# EAGLE board Mk4 Prototype (EAGLE 9.0.1), part 2 of 2 (continued)
## Tracks (layer width: path | path; a pad name or v marks a point on that pad's centre or on a via) (continued)
SDRAM_BA0  (via drill 0.3)
  Top 0.15: v39.3,48 v39.3,60 40.32,61.02 41.27,61.02 41.79,60.5 42.18,60.5 42.35,60.67 42.89,60.67 43.52,61.3 46.26,61.3 46.58,60.98 47.02,60.98 47.32,61.27 55.7,61.27 56.13,60.84 57.3,60.84 57.8,60.34 v57.8,59.5
  Bottom 0.15: IC2.50 33.2,59.9 33.3,60 v39.3,60 | IC2.20 43.15,47.9 43.05,48 v39.3,48 | v57.8,59.5 58,59.7 IC1.76
SDRAM_BA1  (via drill 0.3)
  Top 0.15: v38.8,47 38.77,47.02 38.77,60.73 v38.8,60.75 38.8,61 39.3,61.5 41.81,61.5 42.33,60.98 42.77,60.98 43.39,61.6 46.16,61.6 46.58,62.02 47.02,62.02 47.47,61.58 55.82,61.58 56.25,61.15 57.65,61.15 58.3,60.5 58.3,59.75 v58.55,59.5
  Bottom 0.15: v38.8,47 43.58,47 IC2.21 | v38.8,60.75 33.3,60.75 33.25,60.7 IC2.51 | v58.55,59.5 58.4,59.65 IC1.77
SDRAM_CKE  (via drill 0.3)
  Top 0.15: v33.55,48.75 33.55,46.49 33.52,46.47 33.52,45.77 37.57,41.73 43.02,41.73 44.27,42.98 44.27,46.48 45.32,47.52 47.69,47.52 47.72,47.5 52.83,47.5 53.07,47.75 53.07,48.07 53.38,48.38 53.92,48.38 54.47,48.92 54.47,49.32 55.26,50.1 59.2,50.1 60.3,51.2 60.3,53.9 62.4,56 v63.3,56
  Bottom 0.15: IC2.37 33.3,49.5 33.55,49.25 v33.55,48.75 | IC1.104 66.45,56.4 66.27,56.23 63.55,56.23 63.32,56 v63.3,56
SDRAM_CLK  (via drill 0.3)
  Top 0.15: v31.05,50.75 31.05,52.18 30.76,52.47 30.76,52.65 32.3,54.19 32.3,57.5 32.8,58 v34.3,58 | v45.2,58.5 v42.78,58.5
  Bottom 0.15: IC2.38 31.5,50.3 v31.05,50.75 | v42.78,58.5 41.29,58.5 41.02,58.77 35.07,58.77 v34.3,58 | IC1.62 48.08,58.4 47.98,58.5 v45.2,58.5
SDRAM_D15  (via drill 0.3)
  Top 0.15: v57.8,62.5 56.74,62.5 56.72,62.48 47.84,62.48 47.39,62.92 46.21,62.92 45.91,62.62 34.17,62.62 v33.8,62.25
  Bottom 0.15: IC2.53 33.25,62.3 33.3,62.25 v33.8,62.25 | IC1.78 58.8,61.5 58.57,61.73 58.41,61.73 58.27,61.86 58.27,62.02 v57.8,62.5
SDRAM_DQMH  (via drill 0.3)
  Top 0.15: v35.05,51.25 35.05,59.75 37.32,62.02 38.52,62.02 38.54,62 42.31,62 42.33,62.02 46.16,62.02 46.46,62.33 47.14,62.33 47.59,61.88 55.95,61.88 56.38,61.45 57.49,61.45 57.54,61.5 59.8,61.5 60.3,61 60.3,59.5 59.55,58.75 v59.55,58
  Bottom 0.15: IC2.39 32.9,51.1 33.05,51.25 v35.05,51.25 | IC1.82 60.4,58.85 v59.55,58
SDRAM_DQML  (via drill 0.3)
  Top 0.15: v42.55,51.75 43.55,51.75 43.8,52 43.8,57.2 43.3,57.7 42.5,57.7 42,58.2 42,59.9 42.47,60.38 43.02,60.38 43.64,61 46.13,61 46.46,60.67 47.14,60.67 47.44,60.98 55.57,60.98 57.05,59.5 57.05,59 58.05,58 v58.8,58
  Bottom 0.15: IC2.15 42.95,51.9 42.8,51.75 v42.55,51.75 | IC1.81 60,59.2 v58.8,58
SIM_CLK  (via drill 0.3)
  Top 0.2: v113.3,28.75 113.3,30.5 112.8,31 112.05,31 110.8,32.25 110.3,32.25 106.55,36 102.3,36 99.8,38.5 v99.8,39 | v99.3,55.15 99.3,54.77 99.7,54.37 99.7,53.05 99.3,52.65 v99.3,48
  Bottom 0.2: J1.C3 114.8,23.52 113.3,25.02 v113.3,28.75 IC10.2 | v99.8,39 99.58,39 99.28,38.7 98.82,38.7 98.25,39.27 98.25,41.23 99.05,42.03 99.05,47.75 v99.3,48 | R27.2 99.3,53.72 99.35,53.77 99.35,54.23 99.3,54.28 v99.3,55.15
SIM_CLK_R
  Bottom 0.2: IC5.16 99.2,51.9 R27.1 C49.2
SIM_CTS
  Bottom 0.2: R34.1 86.3,38.25 TP4.TP
SIM_CTS_R
  Bottom 0.15: IC5.4 R34.2
SIM_D_N
  Bottom 0.25: IC5.26 109.15,42.65 109.5,43 109.9,43 arc90 111.6,44.7 111.6,49.07 arc-90 JP9.2
SIM_D_P
  Bottom 0.25: IC5.25 109.15,43.75 109.5,43.4 109.9,43.4 arc90 111.2,44.7 111.2,49.06 arc90 JP9.3
SIM_DATA  (via drill 0.3)
  Top 0.2: v111.55,23.5 v114.05,26 | v114.05,29.25 114.05,30.25 112.8,31.5 112.05,31.5 110.8,32.75 110.3,32.75 106.55,36.5 102.3,36.5 100.55,38.25 v100.55,38.75 | v98.3,48 98.3,52.15 99.35,53.2 99.35,54.23 99.03,54.55 98.75,54.55 v98.3,55
  Bottom 0.2: J1.C7 110.67,23.5 v111.55,23.5 | v114.05,26 v114.05,29.25 113.8,29.5 IC10.1 | v100.55,38.75 100.33,38.75 99.93,38.35 98.68,38.35 97.9,39.13 97.9,41.37 98.55,42.02 98.55,47.75 v98.3,48 | R26.2 97.3,54 v98.3,55
SIM_DATA_R
  Bottom 0.2: C50.2 R26.1 97.3,51.5 98.1,50.7 IC5.15
SIM_DCD
  Bottom 0.2: R33.1 87.8,39.25 TP3.TP
SIM_DCD_R
  Bottom 0.15: IC5.5 90.4,39.35 R33.2
SIM_DET  (via drill 0.3)
  Top 0.2: v97,34 107.55,34 110.3,31.25 110.8,31.25 111.05,31 v111.05,30.6
  Bottom 0.2: IC5.14 v97,34 97,33.65 97.55,33.1 97.55,31.29 97.3,31.04 R29.2 | J1.C8 109.8,26.91 109.8,29.35 v111.05,30.6
SIM_DTR
  Bottom 0.2: R31.1 88.05,41.25 TP2.TP
SIM_DTR_R
  Bottom 0.15: R31.2 R40.1 90.5,40.45 IC5.6
SIM_NETLIGHT
  Bottom 0.15: R42.1 85.65,31.25 84,32.9 84,38.4 83.3,39.1 82.36,39.1 79.6,41.86 79.6,43.37 77.97,44.99 77.97,45.53 77.32,46.19 76.82,46.19 76.3,46.7 74.9,46.7 74.2,47.4 74.2,52.2 71.4,55 69.12,55 69.02,54.9 68.6,54.9 68.5,54.8 IC1.108
SIM_PWR_KEY
  Bottom 0.15: Q1.1 89.22,29 R30.1 87.2,29 86.8,29.4 84.8,29.4 84.5,29.7 83.7,30.5 83.7,38.2 83.1,38.8 82.23,38.8 79.3,41.73 79.3,43.24 77.67,44.87 77.67,45.41 77.2,45.88 76.69,45.88 76.18,46.4 74.7,46.4 73.9,47.2 73.9,52.08 71.28,54.7 69.25,54.7 69.15,54.6 68.8,54.6 68.6,54.4 IC1.109
SIM_RI_R
  Bottom 0.15: IC5.7 91,41.55 R32.2
SIM_RST  (via drill 0.3)
  Top 0.2: v111.8,30 111.8,30.75 110.8,31.75 110.3,31.75 106.55,35.5 102.3,35.5 99.05,38.75 v99.05,39.25 | v100.3,54 v100.3,48
  Bottom 0.2: J1.C2 115.8,20.98 112.3,24.48 112.3,28.5 111.8,29 v111.8,30 111.8,31 112.22,31.43 IC10.4 | v99.05,39.25 99.05,40.25 99.55,40.75 99.55,47.25 v100.3,48 | R28.2 v100.3,54
SIM_RST_R
  Bottom 0.2: IC5.17 R28.1 C48.2
SIM_RTS
  Bottom 0.2: TP5.TP R35.1
SIM_RTS_R
  Bottom 0.15: IC5.3 92.35,37.25 R35.2 R39.1
SIM_RXD_R
  Bottom 0.15: IC5.2 91.1,36.05 R37.2 R38.1
SIM_STATUS
  Bottom 0.15: R41.1 86.35,32.25 84.3,34.3 84.3,38.6 83.5,39.4 82.48,39.4 79.9,41.98 79.9,43.49 78.28,45.12 78.28,45.66 77.45,46.48 76.94,46.48 76.43,47 75.1,47 74.5,47.6 74.5,52.1 74.5,52.2 74.5,52.4 71.6,55.3 69,55.3 68.9,55.2 IC1.107
SIM_STATUS_R
  Bottom 0.15: R41.2 95.85,32.25 IC5.42
SIM_TXD_R
  Bottom 0.15: IC5.1 91.5,34.95 91.05,34.5 91.05,33.5 90.8,33.25 R36.2
SIM_VBUS
  Bottom 0.25: IC5.24 109.15,44.85 arc90 109.8,45.5 109.8,49.19 JP9.4
SIM_VDD  (via drill 0.3)
  Top 0.3: v114.8,31 114.8,31.25 112.8,33.25 110.55,33.25 106.8,37 102.55,37 101.3,38.25 v101.3,38.5
  Bottom 0.3: C51.2 115.3,14.5 115.3,17.25 116.49,18.44 J1.C1 118.8,19.33 118.8,26.95 118.3,27.45 115.35,27.45 114.8,28 v114.8,31 114.38,31.43 IC10.5 | v101.3,38.5 101.15,38.65 101.15,39 100.8,39.35 100.45,39.35 100.05,39.75 100.05,46.75 101.4,48.1 IC5.18
SOP0  (via drill 0.3)
  Top 0.2: v13.85,28.55 13.7,28.55 12.5,28.55 12.3,28.75 11.05,30 11.05,31.25 10.55,31.75 9.55,31.75 8.8,32.5 v8.8,32.75
  Bottom 0.2: IC15.35 14.55,27.85 v13.85,28.55 | R64.1 v8.8,32.75
SOP1  (via drill 0.3)
  Top 0.2: v7.8,32.75 9.8,30.75 9.8,29.25 10.05,29 11.27,29 12.47,27.8 v13.8,27.8
  Bottom 0.2: IC15.34 14.05,27.55 v13.8,27.8 | R63.1 v7.8,32.75
SOP2
  Bottom 0.15: IC15.21 12.3,20.75 11.97,20.43 11.97,17.43 R62.1
SPK_AMP_N  (via drill 0.3)
  Top 0.2: v27.05,52 26.8,52.25 26.8,57 v25.3,58.5
  Bottom 0.2: v25.3,58.5 12.3,58.5 U5.- | IC13.8 26.52,51.48 v27.05,52
SPK_AMP_P
  Bottom 0.2: IC13.5 24.57,51.73 24.3,52 15.3,52 10.8,47.5 U5.+
SPK_N  (via drill 0.3)
  Top 0.2: v48.8,29.9 49.02,29.68 72.23,29.68 75.62,33.07 75.62,45.74 77.23,47.34 79.12,47.34 v79.39,47.62 79.56,47.45 v82.4,47.45 | v30.1,38.7 30.07,38.67 29.37,38.67 26.67,41.37 26.67,42.67 v27.2,43.2
  Bottom 0.2: IC5.12 92.4,47 C68.2 | C65.1 C68.2 | C67.1 C64.2 | C64.2 C68.2 | C64.2 88.97,46.67 84.22,46.67 84.07,46.83 82.82,46.83 82.4,47.25 v82.4,47.45 | v48.8,29.9 48.57,29.68 47.57,29.68 46.07,31.18 44.97,31.18 37.67,38.48 30.32,38.48 v30.1,38.7 | C82.2 24.6,43.25 25.2,42.65 26.65,42.65 v27.2,43.2 | v79.39,47.62 79.9,47.11 79.9,47.05 80.45,46.5 R43.1
SPK_P  (via drill 0.3)
  Top 0.2: v48.8,29.1 49.02,29.32 72.37,29.32 75.97,32.93 75.97,45.59 77.37,46.99 79.17,46.99 v79.55,46.61 | v30.1,37.9 29.67,38.33 29.23,38.33 26.32,41.23 26.32,43.12 v26.4,43.2
  Bottom 0.2: IC5.11 90.35,45.95 C68.1 | C68.1 C64.1 | C69.1 C68.1 | C66.1 C64.1 | C64.1 88.97,46.33 84.08,46.33 83.93,46.48 81.57,46.48 R45.1 80.77,45.72 80.34,45.72 79.55,46.51 v79.55,46.61 | v30.1,37.9 30.32,38.12 37.53,38.12 44.83,30.82 45.93,30.82 47.43,29.32 48.57,29.32 v48.8,29.1 | C83.2 25.6,43.2 v26.4,43.2
SPK_R_N
  Bottom 0.15: R45.2 R46.1 81.55,51 81.55,51.05 81.55,51.23 IC11.5
SPK_R_P
  Bottom 0.15: R43.2 R51.1 R50.1 80.55,51 80.55,51.09 80.55,51.27 IC11.6
SSI0_LCD_CLK
  Bottom 0.15: J2.37 54.05,38.5 55,39.45 55,41.1 53.4,42.7 51.55,42.7 51,43.25 51,47.3 51.3,47.6 IC1.35
SSI0_LCD_CS
  Bottom 0.15: J2.38 53.55,38.5 54.67,39.62 54.67,40.92 54.3,41.29 54.3,41.38 53.28,42.4 51.42,42.4 50.7,43.12 50.7,47.42 51.28,48 IC1.36
SSI0_LCD_MISO  (via drill 0.3)
  Top 0.15: v53.6,39.8 54.1,39.8 55.3,41 v56.25,41
  Bottom 0.15: IC1.38 51.1,48.8 50.1,47.8 50.1,42.88 51.18,41.8 53,41.8 53.6,41.2 v53.6,39.8 | v56.25,41 56.05,40.8 J2.33
SSI0_LCD_MOSI  (via drill 0.3)
  Top 0.15: v54.15,40.7 54.5,40.7 55.5,41.7 v55.85,41.7
  Bottom 0.15: J2.34 55.55,38.5 55.6,38.55 55.6,41.45 v55.85,41.7 | IC1.37 51.2,48.4 50.4,47.6 50.4,43 51.3,42.1 53.15,42.1 54,41.25 54,41.1 54.15,40.95 v54.15,40.7
SSI2_CC_!CS  (via drill 0.3)
  Top 0.15: v30.8,28 31.5,28 36.2,32.7 44.7,32.7 45.9,31.5 56.98,31.5 57.68,32.2 v59.3,32.2 | v65.8,43.2 65.8,42.91 65.4,42.51 65.4,34.6 v64.4,33.6
  Bottom 0.15: IC15.8 17.55,14.9 18.05,14.4 18.55,14.4 19.1,14.95 26.75,14.95 27.8,16 27.8,18.8 30.1,21.1 30.1,27.35 30.75,28 v30.8,28 | IC1.3 65.2,43.8 v65.8,43.2 | v64.4,33.6 61.26,33.6 60.76,34.1 60,34.1 59.3,33.4 v59.3,32.2
SSI2_CC_CLK  (via drill 0.3)
  Top 0.15: v30.8,30.4 32.63,30.4 35.83,33.6 45.2,33.6 46.4,32.4 56.6,32.4 58.6,34.4 v61.2,34.4 | v65,43.2 65,41.49 65.02,41.47 65.02,35.02 v64.4,34.4
  Bottom 0.15: IC15.5 19.05,17.5 20.6,15.95 24.68,15.95 24.7,15.93 26.39,15.93 26.9,16.43 26.9,19.2 29.2,21.5 29.2,28.8 v30.8,30.4 | IC1.4 64.8,43.4 v65,43.2 | v61.2,34.4 v64.4,34.4
SSI2_CC_MISO  (via drill 0.3)
  Top 0.15: v30.8,28.8 31.88,28.8 36.08,33 44.88,33 46.08,31.8 56.85,31.8 57.8,32.75 v60.4,32.75 | v66.55,43.24 66.33,43.01 66.33,42.98 65.7,42.36 65.7,33.8 64.7,32.8 v64.4,32.8
  Bottom 0.15: IC15.7 18.05,17 R71.1 18.8,16.75 20.3,15.25 26.56,15.25 27.5,16.18 27.5,18.95 29.8,21.25 29.8,27.8 v30.8,28.8 | IC1.1 66,44.6 66.4,44.2 66.4,43.39 v66.55,43.24 | v64.4,32.8 64.35,32.75 v60.4,32.75
SSI2_CC_MOSI  (via drill 0.3)
  Top 0.15: v30.8,29.6 32.25,29.6 35.95,33.3 45,33.3 46.2,32.1 56.73,32.1 58.13,33.5 v60.4,33.5 | v65.8,44 66.7,44 67.3,43.4 67.3,42.8 66.7,42.2 66.5,42.2 66,41.7 66,33.4 64.6,32 v64.4,32
  Bottom 0.15: IC15.6 18.55,17.5 20.4,15.65 24.55,15.65 24.58,15.62 26.52,15.62 27.2,16.31 27.2,19.07 29.5,21.37 29.5,28.3 v30.8,29.6 | IC1.2 65.6,44.2 v65.8,44 | v60.4,33.5 60,33.5 59.8,33.3 59.8,32.6 60.4,32 v64.4,32
SSI3_CLK
  Bottom 0.15: IC6.6 69.13,42.5 64.7,42.5 64.4,42.8 IC1.5
SSI3_DAT0  (via drill 0.3)
  Top 0.15: v62.5,47.2 62.25,46.95 62.25,46.35 62,46.1 62,42 62.6,41.4 62.6,40.3 v62.5,40.2
  Bottom 0.15: IC1.11 62,46.1 62.25,46.35 62.25,46.95 v62.5,47.2 | IC6.5 64.95,41.24 63.91,40.2 v62.5,40.2
SSI3_DAT1  (via drill 0.3)
  Top 0.15: v74.1,43.8 68.06,43.8 66.6,45.26 66.6,47.5 64.5,49.6 63.25,49.6 63.15,49.5 62.4,49.5 62.1,49.8 60.45,49.8 60.15,49.5 56,49.5 55.6,49.1 55.6,47.94 55.38,47.72 55.38,47.28 55.6,47.06 v55.6,46.6
  Bottom 0.15: IC1.27 v55.6,46.6 | IC6.2 74.11,43.78 v74.1,43.8
SSI3_DAT2  (via drill 0.3)
  Top 0.15: v74.1,42.5 73.1,43.5 67.9,43.5 67.15,44.25 67.08,44.33 66.3,45.1 66.3,47.38 64.38,49.3 63.38,49.3 63.28,49.2 62.27,49.2 61.97,49.5 60.58,49.5 60.28,49.2 56.4,49.2 55.9,48.7 v55.9,47.5
  Bottom 0.15: IC6.3 74.11,42.52 v74.1,42.5 | v55.9,47.5 55.6,47.5 55.1,47 54.5,47 54.22,47.27 54.22,47.32 54.2,47.34 54.2,48.25 54.52,48.58 55.22,48.58 55.44,48.8 55.6,48.8 55.8,49 55.8,51.1 54.47,52.42 53.58,52.42 53.16,52 IC1.46
  Bottom 0.2: IC6.3 77.53,42.52 R10.2
SSI3_DAT3
  Bottom 0.15: R9.2 66.7,44.35 66.7,46 66.42,46.27 64.97,46.27 63.9,47.35 63.3,47.35 63.07,47.58 63.07,48.7 63.58,49.2 63.68,49.2 64.88,50.4 IC1.119
  Bottom 0.2: IC6.7 69.11,43.75 R9.2
SSI3_FSS  (via drill 0.3)
  3V3@2 0.15: v71.4,42.2 71.4,42.6 71.4,42.7 73.75,45.05 v74.05,45.05
  Bottom 0.15: IC1.6 64,42.5 64.6,41.9 70.5,41.9 70.8,42.2 v71.4,42.2 | v74.05,45.05 IC6.1
SW
  Bottom 0.25: IC3.6 32.9,14.35
  Bottom 0.5: 32.9,14.35 L4.1
T3CCPO_WS2812  (via drill 0.3)
  Top 0.2: 49.8,72.35 49.8,70 53.6,66.2 56.8,66.2 57.7,65.3 59.6,65.3 62,62.9 70.4,62.9 v75.6,57.7 | v75.6,55.3 77,53.9 77,51.5 74.1,48.6 v70.1,48.6
  Top 0.3: LED1.4 49.8,72.35
  Bottom 0.2: v75.6,57.7 v75.6,55.3 | v70.1,48.6 69.83,48.33 69.16,48.33 68.84,48 IC1.125
T_X
  Bottom 0.15: J2.44 50.55,38.35 49.8,39.1 49.8,40.8 49.8,40.9 49.8,50.4 50.2,50.8 IC1.43
T_Y
  Bottom 0.15: IC1.44 50.1,51.2 49.5,50.6 49.5,38.92 50.05,38.37 J2.45
TCA_INT  (via drill 0.3)
  Top 0.15: v53.5,34.5 53.8,34.2 55.86,34.2 59.3,37.64 59.3,39 59.8,39.5 59.8,40 57.7,42.1 57.7,44.1 v60.2,46.6
  Bottom 0.15: 73.8,27.25 54.25,27.25 53.5,28 v53.5,34.5 | IC1.15 60.4,46.4 v60.2,46.6
  Bottom 0.2: IC4.22 75.3,26.25 74.85,26.7 74.85,26.92 74.52,27.25 73.8,27.25
TCK_SWCLK  (via drill 0.3)
  Top 0.2: v81.55,63.75 v81.55,67.25
  Bottom 0.2: J3.4 90.97,63.83 87.8,67 81.8,67 v81.55,67.25 | JP4.4 82.94,61.36 81.55,62.75 v81.55,63.75 81.35,63.95 81.35,63.98 81.03,64.3 80.57,64.3 80.52,64.25 77.05,64.25 70.8,58 IC1.100
TDI
  Bottom 0.2: J3.8 88.43,64.87 87.3,66 79.05,66 78,64.95 76.76,64.95 74.81,63 74.8,63 70.6,58.8 IC1.98
TDO_SWO  (via drill 0.3)
  Top 0.2: v80.8,66.75 v80.8,63.75
  Bottom 0.2: J3.6 89.7,64.35 87.55,66.5 81.05,66.5 v80.8,66.75 80.55,66.5 78.8,66.5 77.6,65.3 76.61,65.3 74.81,63.5 74.8,63.5 70.5,59.2 IC1.97 | JP4.6 82.46,60.09 80.8,61.75 v80.8,63.75
TMS_SWDIO  (via drill 0.3)
  Top 0.2: v82.3,67.75 v82.3,63.75
  Bottom 0.2: J3.2 92.24,63.31 88.05,67.5 82.55,67.5 v82.3,67.75 | JP4.2 82.92,62.63 82.3,63.25 v82.3,63.75 82.3,64 81.55,64.75 78.3,64.75 78.15,64.6 76.91,64.6 74.8,62.5 70.7,58.4 IC1.99
TPS_FB
  Bottom 0.25: IC3.2 R61.1 R60.2 C103.2
UART1_SIM_RI  (via drill 0.3)
  Top 0.15: v75.9,52.6 71.3,52.6 70.8,52.1 66.9,52.1 v66.2,52.8
  Bottom 0.15: R32.1 88.77,42.25 88.52,42.5 81.15,42.5 80.8,42.85 80.8,43.9 79.57,45.12 79.54,45.12 79.17,45.49 79.17,46.03 77.82,47.38 77.31,47.38 76.8,47.9 75.7,47.9 75.4,48.2 75.4,52.1 v75.9,52.6 | IC1.112 66.6,53.2 v66.2,52.8
UART1_SIM_RX  (via drill 0.3)
  Top 0.15: v65.7,59.1 65.8,59 72.35,59 v73.15,58.2
  Bottom 0.15: R36.1 85.8,33.25 84.6,34.45 84.6,38.75 83.65,39.7 82.6,39.7 80.2,42.1 80.2,43.62 78.57,45.24 78.57,45.78 77.57,46.78 77.07,46.78 76.55,47.3 75.28,47.3 74.8,47.78 74.8,52.88 74.6,53.08 74.6,54.35 74.3,54.65 74.3,57.05 v73.15,58.2 | IC1.95 65.6,59.2 v65.7,59.1
UART1_SIM_TX  (via drill 0.3)
  Top 0.15: v66.3,59.6 72.5,59.6 v73.9,58.2
  Bottom 0.15: R37.1 86.05,35.25 84.9,36.4 84.9,38.9 83.8,40 82.73,40 80.5,42.23 80.5,43.74 78.88,45.37 78.88,45.91 77.7,47.09 77.19,47.09 76.68,47.6 75.4,47.6 75.1,47.9 75.1,53 74.9,53.2 74.9,54.48 74.6,54.78 74.6,57.5 v73.9,58.2 | IC1.96 66,59.9 v66.3,59.6
UART3_CC_RX  (via drill 0.3)
  Top 0.15: v23.55,19.75 24.55,18.75 24.55,16.25 25.55,15.25 26.05,15.25 26.6,15.8 26.6,16.87 27.3,17.57 27.3,19.15 27.6,19.45 27.6,20.67 29.75,22.82 29.75,31.37 30.68,32.3 33.26,32.3 35.46,34.5 45.9,34.5 47.1,33.3 56.23,33.3 60.2,37.27 60.2,38.4 60.7,38.9 60.7,40.5 58.6,42.6 58.6,43.5 60.57,45.48 60.67,45.48 61.4,46.21 61.4,46.63 61.62,46.86 61.62,47.54 61.05,48.12 v61.05,48.5
  Bottom 0.15: IC15.55 22.3,23.25 23.15,22.4 23.15,20.15 v23.55,19.75 R68.1 | IC1.116 64.7,51.6 64.3,51.2 63.75,51.2 v61.05,48.5
UART3_CC_TX  (via drill 0.3)
  Top 0.15: v23.55,17.75 24.25,17.05 24.25,16.05 25.35,14.95 26.25,14.95 26.9,15.6 26.9,16.75 27.6,17.45 27.6,19.03 27.9,19.33 27.9,20.55 30.05,22.7 30.05,31.25 30.8,32 33.38,32 35.58,34.2 45.6,34.2 46.8,33 56.35,33 60.5,37.15 60.5,38.22 61,38.72 61,40.7 60.9,40.8 60.9,45.28 61.7,46.09 61.7,46.51 61.92,46.73 61.92,48.38 v61.8,48.5
  Bottom 0.15: IC15.57 22.05,22.25 22.45,21.85 22.45,18.85 v23.55,17.75 R69.1 | IC1.117 64.8,51.2 64.4,50.8 64.1,50.8 v61.8,48.5
UART5_EXT_RX  (via drill 0.3)
  Top 0.15: PCB.CH3 15.84,8.64 17.3,10.1 25.2,10.1 26.9,11.8 26.9,13.8 27.9,14.8 27.9,16.38 28.8,17.28 28.8,20.18 31.5,22.88 v31.5,23.5 | v59.2,39.7 59,39.5 59,37.77 55.73,34.5 54.5,34.5 53.8,35.2 52.6,35.2 51.9,34.5 46.9,34.5 46.3,35.1 35.21,35.1 33.31,33.2 v30.8,33.2
  Bottom 0.15: v59.2,39.7 58.98,39.92 58.98,41.57 58.5,42.05 58.5,43.68 59.2,44.38 IC1.18 | v30.8,33.2 31.8,32.2 31.8,23.8 v31.5,23.5
UART5_EXT_TX  (via drill 0.3)
  Top 0.15: PCB.CH4 12.39,10.4 25.08,10.4 26.6,11.92 26.6,13.92 27.6,14.92 27.6,16.5 28.5,17.4 28.5,20.3 30.7,22.5 30.7,23.8 v31,24.1 | v58.45,39.7 58.7,39.45 58.7,37.89 55.61,34.8 54.7,34.8 54,35.5 52.4,35.5 51.7,34.8 47.1,34.8 46.5,35.4 35.08,35.4 33.68,34 v30.8,34
  Bottom 0.15: v58.45,39.7 58.68,39.93 58.68,41.42 58.15,41.95 58.15,43.75 58.8,44.4 IC1.19 | v31,24.1 31.5,24.6 31.5,31.7 30.7,32.5 30.6,32.6 30.2,33 30.2,33.4 v30.8,34
USB_D_N
  Bottom 0.2: IC7.1 69.3,69.75
  Bottom 0.25: 69.3,69.75 68.5,68.95 68.5,67.45 69.4,66.55 69.4,66.35 69.45,66.3 69.45,65 arc-90 68.45,64 66.6,64 arc90 64.8,62.2 IC1.93 | U1.D- 69.35,71.75 69.4,71.7 69.4,70.5 69.3,70.4 IC7.1
USB_D_P
  Bottom 0.2: IC7.2 69.8,68.15 69.95,68
  Bottom 0.25: 69.95,68 69.95,66.4 69.85,66.3 69.85,65 arc-90 68.45,63.6 66.6,63.6 arc90 65.2,62.2 IC1.94 | U1.D+ 70,71.9 69.8,71.7 IC7.2
USB_ID
  Bottom 0.15: TP6.TP 72.05,65.5 R8.2
USB_ID_R
  Bottom 0.15: U1.ID 70.65,71.4 71.3,70.75 71.3,69.85 70.3,68.85 IC7.4 70.8,68.08 R8.1
USB_SHIELD
  Bottom 0.3: U1.SHIELD@5 74.19,73.7 U1.SHIELD@2 71.64,75.22 U1.SHIELD@1 69.39,75.41 69.21,75.59 U1.SHIELD@0 68.76,75.78 U1.SHIELD@3 66.92,75.07 U1.SHIELD 65.85,73.05 R7.1 64.42,72.5 C20.2
V_UNREG  (via drill 0.3)
  Top 0.2: v45.01,25.6 47.1,25.6 47.88,24.82 47.88,16.86 47.8,16.79 v47.8,15.45
  3V3@2 0.2: v41.55,31.25 41.55,27.25 43.2,25.6 v45.01,25.6
  3V3@2 1.25: v42.5,15.5 v43.3,15.5 43.35,15.45 v47.8,15.45 72.8,15.45 75.05,13.2 79.35,13.2 v81.05,11.5 v84.3,11.5 v85.3,11.5
  Bottom 0.2: 41.3,21.45 IC8.15 41.3,21 | IC8.16 40.8,21 | R18.2 v41.55,31.25
  Bottom 1.25: 91.42,5.38 v85.3,11.5 v81.05,11.5
  Bottom 1.5: PCB.VBATT 91.42,5.38
  pour Bottom (no thermals): 35.3,19 35.3,17.5 36.8,17.5 37.3,17 37.3,15.5 40.8,15.5 41.3,15 43.55,15 43.8,15.25 43.8,15.75 43.55,16 41.8,16 40.8,17 40.8,17.5 41.35,18.05 41.35,21.45 41.3,21.5 40.8,21.5 40.5,21.2 40.5,18.45 39.8,17.75 37.8,17.75 37.3,18.25 37.3,19
VBAT  (via drill 0.3)
  Bottom 0.15: IC8.14 41.8,21.35 | 42.6,20 C35.1 | IC8.13 42.3,21.35
  Bottom 1: J5.2 80.95,16.8 C34.1 | C34.1 79.4,16.65 v79.3,16.75 | C34.1 v80.8,18
  other vias: 42.3,18.5 43.05,18.5
  pour Bottom (no thermals): 41.8,21.55 41.8,18.2 42,18 43.3,18 43.55,18.3 43.55,18.75 43.05,19.25 43.05,20.9 42.4,21.55
  pour 3V3@2 (no thermals): 80.3,16 43.3,16 42.05,17.25 42.05,18.75 42.3,19 43.3,19 44.3,18 78.8,18 79.3,18.5 80.8,18.5 81.3,18 81.3,17
VBATT  (via drill 0.3)
  Top 0.5: LED2.1 68.85,71.5 v66.55,71.5 | LED1.1 54.9,72.25 v56.05,72.25
  3V3@2 0.15: v30,13 30,11.6 30.3,11.3 33.95,11.3 34.3,11.65 v34.3,13
  3V3@2 0.5: 59.8,72.5 65.55,72.5 v66.55,71.5 | v30.8,62 32.3,62
  3V3@2 1: JP2.2 59.8,72.5 56.3,72.5 v56.05,72.25 42.05,72.25 36.3,66.5 33.8,66.5 32.3,65 32.3,62 32.3,32.2 32.3,27.5 35.3,24.5 35.3,23.5 35.25,23.45 35.25,19.36 34.3,18.41 v34.3,13
  Bottom 0.25: IC3.1 30.35,13.35 v30,13
  Bottom 0.5: C1.1 JP2.2 | SJ1.3 v30.8,62
  other vias: 40.55,13.25 39.8,13.25 39.05,13.25 93.05,22.5 90.55,23.5 92.05,22.5 91.3,22.5
  pour Bottom (no thermals): 39.15,14.4 40.6,14.4 40.6,13.7 40.8,13.5 40.8,12.75 40.3,12.25 34.45,12.25 34.45,13.5 38.8,13.5 39.15,13.85
  pour Bottom (no thermals): 90.05,23 90.05,24.5 90.55,25 101.05,25 101.8,25.75 101.8,30 102.05,30.25 103.05,30.25 103.3,30.5 103.3,33 104.8,33 104.8,30.2 104.4,29.8 102.8,29.8 102.55,29.55 102.55,25 100.55,23 94.05,23 93.3,22.25 90.8,22.25
  pour 3V3@2 (no thermals): 91.8,25.5 94.3,25.5 95.3,24.5 95.3,23 94.8,22.5 85.3,22.5 83.3,20.5 41.8,20.5 40.8,19.5 40.8,13 40.55,12.75 39.05,12.75 38.55,13.25 38.55,20.5 40.05,22 81.8,22 84.3,24.5 90.8,24.5
  pour Bottom (no thermals): 32,13.9 32,13.8 32.55,13.8 32.9,13.45 32.9,12.25 34.6,12.25 34.6,13.5 33.95,13.5 33.6,13.85 32.8,13.85 32.75,13.9
VBUS  (via drill 0.3)
  Top 0.2: v67.55,67.25 68.75,67.25 v69.25,67.75
  3V3@2 0.2: v45.3,28.75 45.3,29.5 42.3,32.5 39.8,32.5
  3V3@2 1: v67.55,67.25 67.3,67.5 45.8,67.5 43.55,65.25 43.55,59.07 43.73,58.89 43.73,58.11 43.55,57.93 43.55,36.25 39.8,32.5 39.8,30.5 v39.3,30 v38.55,30
  Bottom 0.15: v69.25,67.75 69.3,67.8 IC7.5
  Bottom 0.2: LED6.A v45.3,28.75
  Bottom 0.5: TP7.TP v67.55,67.25
  Bottom 1: L2.2 v67.55,67.25
  pour Bottom (no thermals): 39.85,25.7 39.85,29.95 39.35,30.45 38.55,30.45 38.05,29.95 38.05,25.8 38.65,25.2 39.4,25.2 39.4,25.7
VBUS_L
  Bottom 0.4: U1.VBUS arc-47 L2.1
VDD_ANA  (via drill 0.3)
  Bottom 0.2: IC15.48 22.35,26.95
  Bottom 0.25: C44.1 13.9,29.4 15.05,28.25 IC15.36 | IC15.25 12.3,22.75 C62.1 v11.8,24
  Bottom 0.4: 22.35,26.95 22.55,26.75 C61.1 v24.05,27.5 | C44.1 v13.15,29.75
  Bottom 0.5: C63.1 11.25,33.6 v10.4,33.6 | C63.1 11.3,32.85 v10.4,32.85 | C63.1 L7.1
  pour 3V3@2 (rank 2, no thermals): 24.55,27.75 24.55,27 24.05,26.5 22.3,26.5 21.55,27.5 14.3,27.5 12.3,25.5 12.3,24 11.8,23.5 11.55,23.5 11.3,23.75 11.3,24.5 11.55,24.75 11.55,27.5 11.05,28 10.3,28 9.8,28.5 9.8,32.3 9.5,32.6 9.5,33.5 10,34 10.6,34 11.05,33.55 11.05,30.25 11.3,30 12.8,30 13.05,30.25 15.45,30.25 17.45,28.25 24.05,28.25
VDD_DIG_CC  (via drill 0.3)
  3V3@2 1: v16.8,16.25 16.8,17 17.3,17.5 21.3,17.5 22.55,18.75 v23.55,18.75 24.05,18.75 25.1,19.8 25.1,20.6 25.6,21.1 26.97,21.1 27.35,21.48 27.35,26.39 28.8,27.84 28.8,31 v27.3,32.5 v27.3,33.25
  Bottom 0.15: IC15.56 22.05,22.75 22.8,22 22.8,19.5 v23.55,18.75 C96.1
  Bottom 0.25: C87.1 26.8,32.9 | 26.8,32.9 26.9,32.9 v27.3,32.5 | 26.8,32.9 27.15,33.25 v27.3,33.25 | IC15.9 17.05,16.5 v16.8,16.25 C97.1
  Bottom 0.4: C87.1 26.05,33 25.85,33.2 23.9,33.2 L9.1
VDD_EXT
  Bottom 0.3: IC5.40 98.1,30.7 R29.1
VDD_PA  (via drill 0.3)
  Bottom 0.25: IC15.42 18.05,28.42 19.25,29.62 19.25,31.45 19.67,31.88 C85.1 | IC15.33 13.45,27.05
  Bottom 0.4: C85.1 C84.1 | C84.1 21.57,32.4 v22.05,32.4 | C84.1 21.52,31.4 v22.05,31.4 | C86.1 13.05,28.88 13.05,27.45 13.45,27.05 | 12.5,29.95 12.5,30.07 | C86.1 12.5,30.07 | 12.5,30.07 v12.5,30.75 | C86.1 11.75,30.18 v11.75,30.75
  pour 3V3@2 (no thermals): 12.8,31.5 12.8,30.5 12.55,30.25 11.55,30.25 11.3,30.5 11.3,32.5 12.8,34 18.3,34 19.3,33 22.05,33 22.55,32.5 22.55,31.5 22.05,31 18.8,31 17.8,32 13.3,32
VDD_PLL
  Bottom 0.25: IC15.24 C94.1
VDD_RAM
  Bottom 0.2: IC15.49 23.55,26.25 C95.1
VDDC
  Bottom 0.2: 66.6,52 IC1.115 68.4,52 | 62.4,59.8 IC1.87 62.4,61.6
  Bottom 0.25: 66.6,52 64.8,52 62.4,54.4 62.4,59.8 | 62.4,61.6 62.4,61.65 C8.2 | 68.4,52 69.42,52 C6.2 C7.2
WFIF_ANT_L
  Bottom 0.4: L6.2 C77.2 2.1,22.8 ANT1.1
WIFI_ANT
  Bottom 0.35: FL1.OUT 10.25,25.75
  Bottom 0.4: L6.1 C76.2 6.3,23 7.3,24 7.3,24.5 8.55,25.75 10.25,25.75
WIFI_ANT_F
  Bottom 0.2: IC15.31 12.45,25.75
  Bottom 0.35: FL1.IN 11.32,25.75
  Bottom 0.4: 12.45,25.75 11.32,25.75
WS2812_OUT
  Top 0.3: LED2.2 68.65,74.5 63.11,74.5 JP2.3
WS28212_1
  Top 0.3: LED2.4 63.4,72.4 62.35,71.35 62.35,71.05 61.05,69.75 58.81,69.75 57.55,71.01 57.55,72 56.8,72.75 56.8,73 56.8,73.25 56.8,73.26 56.02,74.04 56.02,74.33 LED1.2
XOSC0
  Bottom 0.15: IC1.66 54,62.7 C18.2 53.7,63.4 53.5,63.6 52.8,63.6 52.65,63.75 X1.P$1
XOSC1
  Bottom 0.15: IC1.67 54.4,62.7 C19.2 54.7,63.4 54.9,63.6 55.6,63.6 55.75,63.75 X1.P$2

## Text on the board
tPlace: 0V | 3.3V | CH1 | I2C5 | FET | GPIO | CH2 | SDA | CH3 | SCL | CH4 | VBATT
bPlace: OFF | ON | MIC | !HIB | 0V | 3.3V | CH1 | GPIO | I2C5 | FET | CH2 | SDA | CH3 | SCL | CH4 | Wake | OFF | ON | Reset | VBATT